# Altium schematic sheet MAZ000151 - Diagrama físico.SchDoc: MAZ000151 - Diagrama físico
size A; ApprovedBy: Christian Ledwidth; CheckedBy: Nahuel Martinez; Author: Santiago Marti; CompanyName: Body Health; DrawnBy: Santiago Marti; Revision: A; SheetNumber: 2; SheetTotal: 2
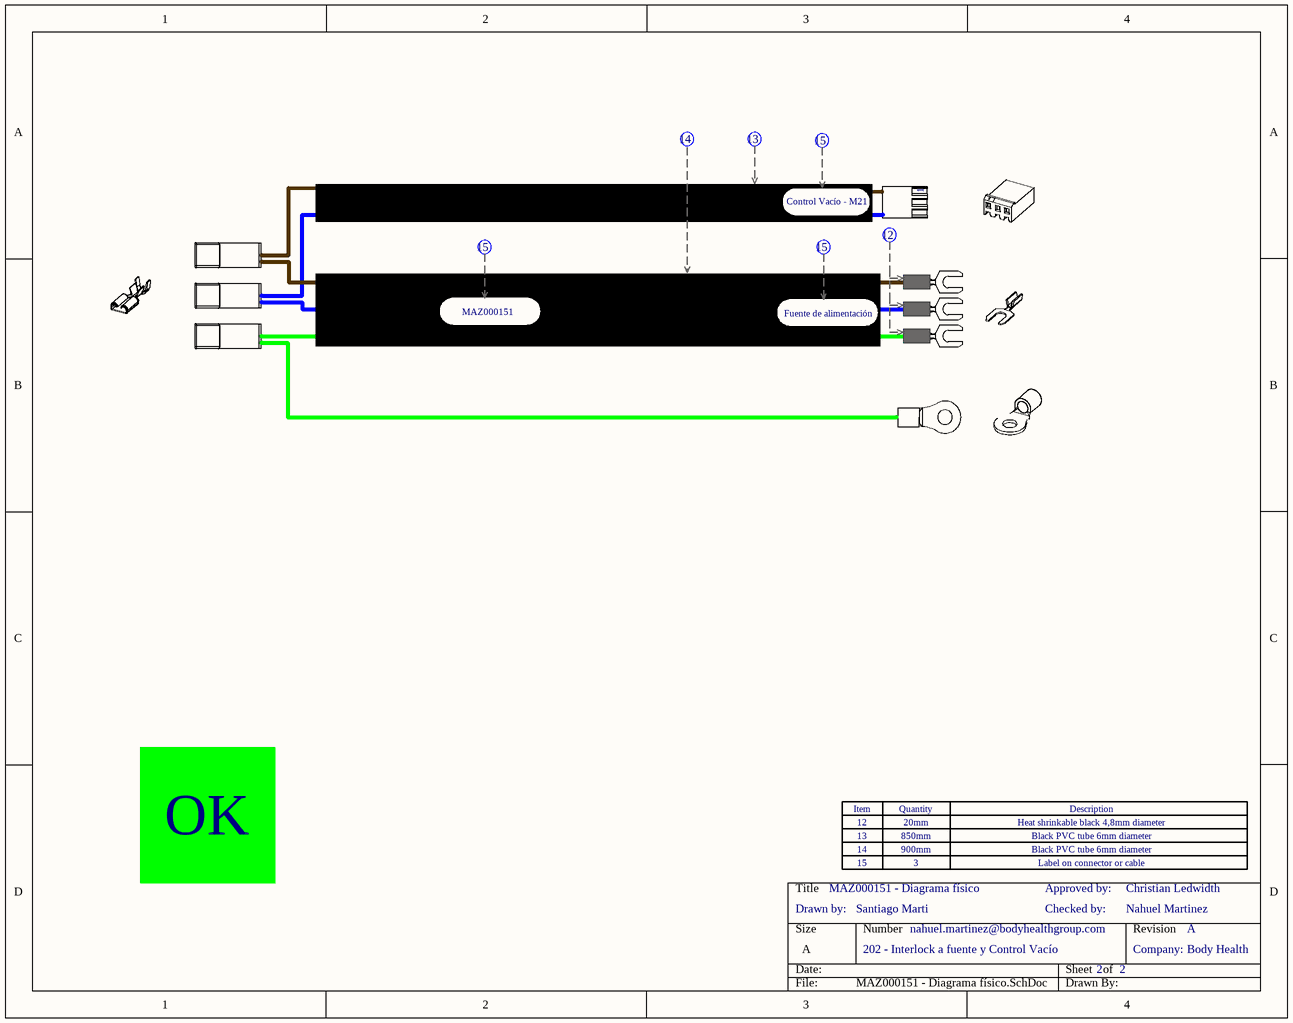
[diagram p0: MAZ000151 - Diagrama físico.SchDoc]

## Parts
(Parts that share a designator on the sheet are numbered #1, #2 ... from top to bottom, then left to right.)
Cab1  Cable  (value not drawn)
Cab2  Cable  (value not drawn)
Cab3  Cable  (value not drawn)
Cab4  Cable  (value not drawn)
Cab?  Cable  (value not drawn)
Con1  SL156-3  (value not drawn)  (parts A,B of 4)
Con2  Shovel  (value not drawn)  (part A of 4)
Con3  Shovel  (value not drawn)  (parts A,B of 4)
Con4  Shovel  (value not drawn)  (part A of 4)
Con5  Ring  (value not drawn)  (parts A,B of 4)
Con?#1  Spade  (value not drawn)  (part A of 4)
Con?#2  Spade  (value not drawn)  (part A of 4)
Con?#3  Spade  (value not drawn)  (part B of 4)
Con?#4  Spade  (value not drawn)  (part A of 4)
Ter?  Termocontraible  (value not drawn)
Zoc1  Zócalo_Header  (value not drawn)
Zoc11  Zócalo_Item  (value not drawn)
Zoc12  Zócalo_Item  (value not drawn)
Zoc?#1  Zócalo_Item  (value not drawn)
Zoc?#2  Zócalo_Item  (value not drawn)

## Notes on the sheet
- Control Vacío - M21
- MAZ000151
- Fuente de alimentación
- OK
- 12
- 13
- 20mm
- 850mm
- Heat shrinkable black 4,8mm diameter
- Black PVC tube 6mm diameter
- (near Zoc?#2) Drawn by:
- 14
- (near Zoc?#1) 15
- 900mm
- 3
- Checked by:
- Approved by:
- Label on connector or cable
- 202 - Interlock a fuente y Control Vacío
- nahuel.martinez@bodyhealthgroup.com
- Company:
- (in symbol Zócalo_Header) Item; Quantity; Description

## Library data of the parts
Cab1 = Cable: CallOut: 13; Largo: *mm; Sección: *mm2; Color: *
Cab2-Cab4 = Cable: CallOut: 15; Largo: *mm; Sección: *mm2; Color: *
Cab? = Cable: CallOut: 14; Largo: *mm; Sección: *mm2; Color: *
Con1 = SL156-3: CONN RECEPT 3 POS W/RAMP SL-156; Cod.Fabricante: 640250-3; Fabricante: TE Connectivity AMP Connectors; Cod.DigiKey: A19951-ND; ComponentLink1Description: Manufacturer Link; ComponentLink1URL: https://www.te.com/commerce/DocumentDelivery/DDEController?Action=srchrtrv&DocNm=640250&DocType=Customer+Drawing&DocLang=English; DIGIKEYx50: 0.14460; CallOut: *; DIGIKEYx100: 0.13430
Con2-Con4 = Shovel: CONN HOUSING SHOVEL M4; Cod.DigiKey: -; Cod.Fabricante: -; ComponentLink1Description: Manufacturer Link; ComponentLink1URL: -; DIGIKEYx50: -; Fabricante: -; CallOut: *; DIGIKEYx100: -
Con5 = Ring: CONN HOUSING RING M4; Cod.DigiKey: -; Cod.Fabricante: -; ComponentLink1Description: Manufacturer Link; ComponentLink1URL: -; DIGIKEYx50: -; Fabricante: -; CallOut: *; DIGIKEYx100: -
Con?#1-Con?#4 = Spade: CONN HOUSING SPADE M4; Cod.DigiKey: -; Cod.Fabricante: -; ComponentLink1Description: Manufacturer Link; ComponentLink1URL: -; DIGIKEYx50: -; Fabricante: -; CallOut: *; DIGIKEYx100: -
Ter? = Termocontraible: CallOut: 12; Largo: *; Diámetro: *
Zoc1 = Zócalo_Header: Header para el zócalo de referencias
Zoc11 Zoc12 Zoc?#1 Zoc?#2 = Zócalo_Item: Ítem para el zócalo de referencias; Desginator: *; Quantity: *; ItemDescription: *